# EAGLE board Resistor_Resistor (EAGLE 8.3.0), part 28 of 32
## Placement (x,y rotation side) (continued)
R34191  10K  [0201]  232.61,117.09 0 top
R34192  10K  [0201]  232.61,117.7 0 top
R34193  10K  [0201]  232.61,118.31 0 top
R34194  10K  [0201]  232.61,118.92 0 top
R34195  10K  [0201]  232.61,119.53 0 top
R34196  10K  [0201]  232.61,120.14 0 top
R34197  10K  [0201]  232.61,120.75 0 top
R34198  10K  [0201]  232.61,121.36 0 top
R34199  10K  [0201]  232.61,121.97 0 top
R34200  10K  [0201]  232.61,122.58 0 top
R34201  10K  [0201]  233.83,1.27 0 top
R34202  10K  [0201]  233.83,1.88 0 top
R34203  10K  [0201]  233.83,2.49 0 top
R34204  10K  [0201]  233.83,3.1 0 top
R34205  10K  [0201]  233.83,3.71 0 top
R34206  10K  [0201]  233.83,4.32 0 top
R34207  10K  [0201]  233.83,4.93 0 top
R34208  10K  [0201]  233.83,5.54 0 top
R34209  10K  [0201]  233.83,6.15 0 top
R34210  10K  [0201]  233.83,6.76 0 top
R34211  10K  [0201]  233.83,7.37 0 top
R34212  10K  [0201]  233.83,7.98 0 top
R34213  10K  [0201]  233.83,8.59 0 top
R34214  10K  [0201]  233.83,9.19 0 top
R34215  10K  [0201]  233.83,9.8 0 top
R34216  10K  [0201]  233.83,10.41 0 top
R34217  10K  [0201]  233.83,11.02 0 top
R34218  10K  [0201]  233.83,11.63 0 top
R34219  10K  [0201]  233.83,12.24 0 top
R34220  10K  [0201]  233.83,12.85 0 top
R34221  10K  [0201]  233.83,13.46 0 top
R34222  10K  [0201]  233.83,14.07 0 top
R34223  10K  [0201]  233.83,14.68 0 top
R34224  10K  [0201]  233.83,15.29 0 top
R34225  10K  [0201]  233.83,15.9 0 top
R34226  10K  [0201]  233.83,16.51 0 top
R34227  10K  [0201]  233.83,17.12 0 top
R34228  10K  [0201]  233.83,17.73 0 top
R34229  10K  [0201]  233.83,18.34 0 top
R34230  10K  [0201]  233.83,18.95 0 top
R34231  10K  [0201]  233.83,19.56 0 top
R34232  10K  [0201]  233.83,20.17 0 top
R34233  10K  [0201]  233.83,20.78 0 top
R34234  10K  [0201]  233.83,21.39 0 top
R34235  10K  [0201]  233.83,22 0 top
R34236  10K  [0201]  233.83,22.61 0 top
R34237  10K  [0201]  233.83,23.22 0 top
R34238  10K  [0201]  233.83,23.83 0 top
R34239  10K  [0201]  233.83,24.43 0 top
R34240  10K  [0201]  233.83,25.04 0 top
R34241  10K  [0201]  233.83,25.65 0 top
R34242  10K  [0201]  233.83,26.26 0 top
R34243  10K  [0201]  233.83,26.87 0 top
R34244  10K  [0201]  233.83,27.48 0 top
R34245  10K  [0201]  233.83,28.09 0 top
R34246  10K  [0201]  233.83,28.7 0 top
R34247  10K  [0201]  233.83,29.31 0 top
R34248  10K  [0201]  233.83,29.92 0 top
R34249  10K  [0201]  233.83,30.53 0 top
R34250  10K  [0201]  233.83,31.14 0 top
R34251  10K  [0201]  233.83,31.75 0 top
R34252  10K  [0201]  233.83,32.36 0 top
R34253  10K  [0201]  233.83,32.97 0 top
R34254  10K  [0201]  233.83,33.58 0 top
R34255  10K  [0201]  233.83,34.19 0 top
R34256  10K  [0201]  233.83,34.8 0 top
R34257  10K  [0201]  233.83,35.41 0 top
R34258  10K  [0201]  233.83,36.02 0 top
R34259  10K  [0201]  233.83,36.63 0 top
R34260  10K  [0201]  233.83,37.24 0 top
R34261  10K  [0201]  233.83,37.85 0 top
R34262  10K  [0201]  233.83,38.46 0 top
R34263  10K  [0201]  233.83,39.07 0 top
R34264  10K  [0201]  233.83,39.67 0 top
R34265  10K  [0201]  233.83,40.28 0 top
R34266  10K  [0201]  233.83,40.89 0 top
R34267  10K  [0201]  233.83,41.5 0 top
R34268  10K  [0201]  233.83,42.11 0 top
R34269  10K  [0201]  233.83,42.72 0 top
R34270  10K  [0201]  233.83,43.33 0 top
R34271  10K  [0201]  233.83,43.94 0 top
R34272  10K  [0201]  233.83,44.55 0 top
R34273  10K  [0201]  233.83,45.16 0 top
R34274  10K  [0201]  233.83,45.77 0 top
R34275  10K  [0201]  233.83,46.38 0 top
R34276  10K  [0201]  233.83,46.99 0 top
R34277  10K  [0201]  233.83,47.6 0 top
R34278  10K  [0201]  233.83,48.21 0 top
R34279  10K  [0201]  233.83,48.82 0 top
R34280  10K  [0201]  233.83,49.43 0 top
R34281  10K  [0201]  233.83,50.04 0 top
R34282  10K  [0201]  233.83,50.65 0 top
R34283  10K  [0201]  233.83,51.26 0 top
R34284  10K  [0201]  233.83,51.87 0 top
R34285  10K  [0201]  233.83,52.48 0 top
R34286  10K  [0201]  233.83,53.09 0 top
R34287  10K  [0201]  233.83,53.7 0 top
R34288  10K  [0201]  233.83,54.31 0 top
R34289  10K  [0201]  233.83,54.91 0 top
R34290  10K  [0201]  233.83,55.52 0 top
R34291  10K  [0201]  233.83,56.13 0 top
R34292  10K  [0201]  233.83,56.74 0 top
R34293  10K  [0201]  233.83,57.35 0 top
R34294  10K  [0201]  233.83,57.96 0 top
R34295  10K  [0201]  233.83,58.57 0 top
R34296  10K  [0201]  233.83,59.18 0 top
R34297  10K  [0201]  233.83,59.79 0 top
R34298  10K  [0201]  233.83,60.4 0 top
R34299  10K  [0201]  233.83,61.01 0 top
R34300  10K  [0201]  233.83,61.62 0 top
R34301  10K  [0201]  233.83,62.23 0 top
R34302  10K  [0201]  233.83,62.84 0 top
R34303  10K  [0201]  233.83,63.45 0 top
R34304  10K  [0201]  233.83,64.06 0 top
R34305  10K  [0201]  233.83,64.67 0 top
R34306  10K  [0201]  233.83,65.28 0 top
R34307  10K  [0201]  233.83,65.89 0 top
R34308  10K  [0201]  233.83,66.5 0 top
R34309  10K  [0201]  233.83,67.11 0 top
R34310  10K  [0201]  233.83,67.72 0 top
R34311  10K  [0201]  233.83,68.33 0 top
R34312  10K  [0201]  233.83,68.94 0 top
R34313  10K  [0201]  233.83,69.55 0 top
R34314  10K  [0201]  233.83,70.15 0 top
R34315  10K  [0201]  233.83,70.76 0 top
R34316  10K  [0201]  233.83,71.37 0 top
R34317  10K  [0201]  233.83,71.98 0 top
R34318  10K  [0201]  233.83,72.59 0 top
R34319  10K  [0201]  233.83,73.2 0 top
R34320  10K  [0201]  233.83,73.81 0 top
R34321  10K  [0201]  233.83,74.42 0 top
R34322  10K  [0201]  233.83,75.03 0 top
R34323  10K  [0201]  233.83,75.64 0 top
R34324  10K  [0201]  233.83,76.25 0 top
R34325  10K  [0201]  233.83,76.86 0 top
R34326  10K  [0201]  233.83,77.47 0 top
R34327  10K  [0201]  233.83,78.08 0 top
R34328  10K  [0201]  233.83,78.69 0 top
R34329  10K  [0201]  233.83,79.3 0 top
R34330  10K  [0201]  233.83,79.91 0 top
R34331  10K  [0201]  233.83,80.52 0 top
R34332  10K  [0201]  233.83,81.13 0 top
R34333  10K  [0201]  233.83,81.74 0 top
R34334  10K  [0201]  233.83,82.35 0 top
R34335  10K  [0201]  233.83,82.96 0 top
R34336  10K  [0201]  233.83,83.57 0 top
R34337  10K  [0201]  233.83,84.18 0 top
R34338  10K  [0201]  233.83,84.79 0 top
R34339  10K  [0201]  233.83,85.39 0 top
R34340  10K  [0201]  233.83,86 0 top
R34341  10K  [0201]  233.83,86.61 0 top
R34342  10K  [0201]  233.83,87.22 0 top
R34343  10K  [0201]  233.83,87.83 0 top
R34344  10K  [0201]  233.83,88.44 0 top
R34345  10K  [0201]  233.83,89.05 0 top
R34346  10K  [0201]  233.83,89.66 0 top
R34347  10K  [0201]  233.83,90.27 0 top
R34348  10K  [0201]  233.83,90.88 0 top
R34349  10K  [0201]  233.83,91.49 0 top
R34350  10K  [0201]  233.83,92.1 0 top
R34351  10K  [0201]  233.83,92.71 0 top
R34352  10K  [0201]  233.83,93.32 0 top
R34353  10K  [0201]  233.83,93.93 0 top
R34354  10K  [0201]  233.83,94.54 0 top
R34355  10K  [0201]  233.83,95.15 0 top
R34356  10K  [0201]  233.83,95.76 0 top
R34357  10K  [0201]  233.83,96.37 0 top
R34358  10K  [0201]  233.83,96.98 0 top
R34359  10K  [0201]  233.83,97.59 0 top
R34360  10K  [0201]  233.83,98.2 0 top
R34361  10K  [0201]  233.83,98.81 0 top
R34362  10K  [0201]  233.83,99.42 0 top
R34363  10K  [0201]  233.83,100.03 0 top
R34364  10K  [0201]  233.83,100.63 0 top
R34365  10K  [0201]  233.83,101.24 0 top
R34366  10K  [0201]  233.83,101.85 0 top
R34367  10K  [0201]  233.83,102.46 0 top
R34368  10K  [0201]  233.83,103.07 0 top
R34369  10K  [0201]  233.83,103.68 0 top
R34370  10K  [0201]  233.83,104.29 0 top
R34371  10K  [0201]  233.83,104.9 0 top
R34372  10K  [0201]  233.83,105.51 0 top
R34373  10K  [0201]  233.83,106.12 0 top
R34374  10K  [0201]  233.83,106.73 0 top
R34375  10K  [0201]  233.83,107.34 0 top
R34376  10K  [0201]  233.83,107.95 0 top
R34377  10K  [0201]  233.83,108.56 0 top
R34378  10K  [0201]  233.83,109.17 0 top
R34379  10K  [0201]  233.83,109.78 0 top
R34380  10K  [0201]  233.83,110.39 0 top
R34381  10K  [0201]  233.83,111 0 top
R34382  10K  [0201]  233.83,111.61 0 top
R34383  10K  [0201]  233.83,112.22 0 top
R34384  10K  [0201]  233.83,112.83 0 top
R34385  10K  [0201]  233.83,113.44 0 top
R34386  10K  [0201]  233.83,114.05 0 top
R34387  10K  [0201]  233.83,114.66 0 top
R34388  10K  [0201]  233.83,115.27 0 top
R34389  10K  [0201]  233.83,115.87 0 top
R34390  10K  [0201]  233.83,116.48 0 top
R34391  10K  [0201]  233.83,117.09 0 top
R34392  10K  [0201]  233.83,117.7 0 top
R34393  10K  [0201]  233.83,118.31 0 top
R34394  10K  [0201]  233.83,118.92 0 top
R34395  10K  [0201]  233.83,119.53 0 top
R34396  10K  [0201]  233.83,120.14 0 top
R34397  10K  [0201]  233.83,120.75 0 top
R34398  10K  [0201]  233.83,121.36 0 top
R34399  10K  [0201]  233.83,121.97 0 top
R34400  10K  [0201]  233.83,122.58 0 top
R34401  10K  [0201]  235.05,1.27 0 top
R34402  10K  [0201]  235.05,1.88 0 top
R34403  10K  [0201]  235.05,2.49 0 top
R34404  10K  [0201]  235.05,3.1 0 top
R34405  10K  [0201]  235.05,3.71 0 top
R34406  10K  [0201]  235.05,4.32 0 top
R34407  10K  [0201]  235.05,4.93 0 top
R34408  10K  [0201]  235.05,5.54 0 top
R34409  10K  [0201]  235.05,6.15 0 top
R34410  10K  [0201]  235.05,6.76 0 top
R34411  10K  [0201]  235.05,7.37 0 top
R34412  10K  [0201]  235.05,7.98 0 top
R34413  10K  [0201]  235.05,8.59 0 top
R34414  10K  [0201]  235.05,9.19 0 top
R34415  10K  [0201]  235.05,9.8 0 top
R34416  10K  [0201]  235.05,10.41 0 top
R34417  10K  [0201]  235.05,11.02 0 top
R34418  10K  [0201]  235.05,11.63 0 top
R34419  10K  [0201]  235.05,12.24 0 top
R34420  10K  [0201]  235.05,12.85 0 top
R34421  10K  [0201]  235.05,13.46 0 top
R34422  10K  [0201]  235.05,14.07 0 top
R34423  10K  [0201]  235.05,14.68 0 top
R34424  10K  [0201]  235.05,15.29 0 top
R34425  10K  [0201]  235.05,15.9 0 top
R34426  10K  [0201]  235.05,16.51 0 top
R34427  10K  [0201]  235.05,17.12 0 top
R34428  10K  [0201]  235.05,17.73 0 top
R34429  10K  [0201]  235.05,18.34 0 top
R34430  10K  [0201]  235.05,18.95 0 top
R34431  10K  [0201]  235.05,19.56 0 top
R34432  10K  [0201]  235.05,20.17 0 top
R34433  10K  [0201]  235.05,20.78 0 top
R34434  10K  [0201]  235.05,21.39 0 top
R34435  10K  [0201]  235.05,22 0 top
R34436  10K  [0201]  235.05,22.61 0 top
R34437  10K  [0201]  235.05,23.22 0 top
R34438  10K  [0201]  235.05,23.83 0 top
R34439  10K  [0201]  235.05,24.43 0 top
R34440  10K  [0201]  235.05,25.04 0 top
R34441  10K  [0201]  235.05,25.65 0 top
R34442  10K  [0201]  235.05,26.26 0 top
R34443  10K  [0201]  235.05,26.87 0 top
R34444  10K  [0201]  235.05,27.48 0 top
R34445  10K  [0201]  235.05,28.09 0 top
R34446  10K  [0201]  235.05,28.7 0 top
R34447  10K  [0201]  235.05,29.31 0 top
R34448  10K  [0201]  235.05,29.92 0 top
R34449  10K  [0201]  235.05,30.53 0 top
R34450  10K  [0201]  235.05,31.14 0 top
R34451  10K  [0201]  235.05,31.75 0 top
R34452  10K  [0201]  235.05,32.36 0 top
R34453  10K  [0201]  235.05,32.97 0 top
R34454  10K  [0201]  235.05,33.58 0 top
R34455  10K  [0201]  235.05,34.19 0 top
R34456  10K  [0201]  235.05,34.8 0 top
R34457  10K  [0201]  235.05,35.41 0 top
R34458  10K  [0201]  235.05,36.02 0 top
R34459  10K  [0201]  235.05,36.63 0 top
R34460  10K  [0201]  235.05,37.24 0 top
R34461  10K  [0201]  235.05,37.85 0 top
R34462  10K  [0201]  235.05,38.46 0 top
R34463  10K  [0201]  235.05,39.07 0 top
R34464  10K  [0201]  235.05,39.67 0 top
R34465  10K  [0201]  235.05,40.28 0 top
R34466  10K  [0201]  235.05,40.89 0 top
R34467  10K  [0201]  235.05,41.5 0 top
R34468  10K  [0201]  235.05,42.11 0 top
R34469  10K  [0201]  235.05,42.72 0 top
R34470  10K  [0201]  235.05,43.33 0 top
R34471  10K  [0201]  235.05,43.94 0 top
R34472  10K  [0201]  235.05,44.55 0 top
R34473  10K  [0201]  235.05,45.16 0 top
R34474  10K  [0201]  235.05,45.77 0 top
R34475  10K  [0201]  235.05,46.38 0 top
R34476  10K  [0201]  235.05,46.99 0 top
R34477  10K  [0201]  235.05,47.6 0 top
R34478  10K  [0201]  235.05,48.21 0 top
R34479  10K  [0201]  235.05,48.82 0 top
R34480  10K  [0201]  235.05,49.43 0 top
R34481  10K  [0201]  235.05,50.04 0 top
R34482  10K  [0201]  235.05,50.65 0 top
R34483  10K  [0201]  235.05,51.26 0 top
R34484  10K  [0201]  235.05,51.87 0 top
R34485  10K  [0201]  235.05,52.48 0 top
R34486  10K  [0201]  235.05,53.09 0 top
R34487  10K  [0201]  235.05,53.7 0 top
R34488  10K  [0201]  235.05,54.31 0 top
R34489  10K  [0201]  235.05,54.91 0 top
R34490  10K  [0201]  235.05,55.52 0 top
R34491  10K  [0201]  235.05,56.13 0 top
R34492  10K  [0201]  235.05,56.74 0 top
R34493  10K  [0201]  235.05,57.35 0 top
R34494  10K  [0201]  235.05,57.96 0 top
R34495  10K  [0201]  235.05,58.57 0 top
R34496  10K  [0201]  235.05,59.18 0 top
R34497  10K  [0201]  235.05,59.79 0 top
R34498  10K  [0201]  235.05,60.4 0 top
R34499  10K  [0201]  235.05,61.01 0 top
R34500  10K  [0201]  235.05,61.62 0 top
R34501  10K  [0201]  235.05,62.23 0 top
R34502  10K  [0201]  235.05,62.84 0 top
R34503  10K  [0201]  235.05,63.45 0 top
R34504  10K  [0201]  235.05,64.06 0 top
R34505  10K  [0201]  235.05,64.67 0 top
R34506  10K  [0201]  235.05,65.28 0 top
R34507  10K  [0201]  235.05,65.89 0 top
R34508  10K  [0201]  235.05,66.5 0 top
R34509  10K  [0201]  235.05,67.11 0 top
R34510  10K  [0201]  235.05,67.72 0 top
R34511  10K  [0201]  235.05,68.33 0 top
R34512  10K  [0201]  235.05,68.94 0 top
R34513  10K  [0201]  235.05,69.55 0 top
R34514  10K  [0201]  235.05,70.15 0 top
R34515  10K  [0201]  235.05,70.76 0 top
R34516  10K  [0201]  235.05,71.37 0 top
R34517  10K  [0201]  235.05,71.98 0 top
R34518  10K  [0201]  235.05,72.59 0 top
R34519  10K  [0201]  235.05,73.2 0 top
R34520  10K  [0201]  235.05,73.81 0 top
R34521  10K  [0201]  235.05,74.42 0 top
R34522  10K  [0201]  235.05,75.03 0 top
R34523  10K  [0201]  235.05,75.64 0 top
R34524  10K  [0201]  235.05,76.25 0 top
R34525  10K  [0201]  235.05,76.86 0 top
R34526  10K  [0201]  235.05,77.47 0 top
R34527  10K  [0201]  235.05,78.08 0 top
R34528  10K  [0201]  235.05,78.69 0 top
R34529  10K  [0201]  235.05,79.3 0 top
R34530  10K  [0201]  235.05,79.91 0 top
R34531  10K  [0201]  235.05,80.52 0 top
R34532  10K  [0201]  235.05,81.13 0 top
R34533  10K  [0201]  235.05,81.74 0 top
R34534  10K  [0201]  235.05,82.35 0 top
R34535  10K  [0201]  235.05,82.96 0 top
R34536  10K  [0201]  235.05,83.57 0 top
R34537  10K  [0201]  235.05,84.18 0 top
R34538  10K  [0201]  235.05,84.79 0 top
R34539  10K  [0201]  235.05,85.39 0 top
R34540  10K  [0201]  235.05,86 0 top
R34541  10K  [0201]  235.05,86.61 0 top
R34542  10K  [0201]  235.05,87.22 0 top
R34543  10K  [0201]  235.05,87.83 0 top
R34544  10K  [0201]  235.05,88.44 0 top
R34545  10K  [0201]  235.05,89.05 0 top
R34546  10K  [0201]  235.05,89.66 0 top
R34547  10K  [0201]  235.05,90.27 0 top
R34548  10K  [0201]  235.05,90.88 0 top
R34549  10K  [0201]  235.05,91.49 0 top
R34550  10K  [0201]  235.05,92.1 0 top
R34551  10K  [0201]  235.05,92.71 0 top
R34552  10K  [0201]  235.05,93.32 0 top
R34553  10K  [0201]  235.05,93.93 0 top
R34554  10K  [0201]  235.05,94.54 0 top
R34555  10K  [0201]  235.05,95.15 0 top
R34556  10K  [0201]  235.05,95.76 0 top
R34557  10K  [0201]  235.05,96.37 0 top
R34558  10K  [0201]  235.05,96.98 0 top
R34559  10K  [0201]  235.05,97.59 0 top
R34560  10K  [0201]  235.05,98.2 0 top
R34561  10K  [0201]  235.05,98.81 0 top
R34562  10K  [0201]  235.05,99.42 0 top
R34563  10K  [0201]  235.05,100.03 0 top
R34564  10K  [0201]  235.05,100.63 0 top
R34565  10K  [0201]  235.05,101.24 0 top
R34566  10K  [0201]  235.05,101.85 0 top
R34567  10K  [0201]  235.05,102.46 0 top
R34568  10K  [0201]  235.05,103.07 0 top
R34569  10K  [0201]  235.05,103.68 0 top
R34570  10K  [0201]  235.05,104.29 0 top
R34571  10K  [0201]  235.05,104.9 0 top
R34572  10K  [0201]  235.05,105.51 0 top
R34573  10K  [0201]  235.05,106.12 0 top
R34574  10K  [0201]  235.05,106.73 0 top
R34575  10K  [0201]  235.05,107.34 0 top
R34576  10K  [0201]  235.05,107.95 0 top
R34577  10K  [0201]  235.05,108.56 0 top
R34578  10K  [0201]  235.05,109.17 0 top
R34579  10K  [0201]  235.05,109.78 0 top
R34580  10K  [0201]  235.05,110.39 0 top
R34581  10K  [0201]  235.05,111 0 top
R34582  10K  [0201]  235.05,111.61 0 top
R34583  10K  [0201]  235.05,112.22 0 top
R34584  10K  [0201]  235.05,112.83 0 top
R34585  10K  [0201]  235.05,113.44 0 top
R34586  10K  [0201]  235.05,114.05 0 top
R34587  10K  [0201]  235.05,114.66 0 top
R34588  10K  [0201]  235.05,115.27 0 top
R34589  10K  [0201]  235.05,115.87 0 top
R34590  10K  [0201]  235.05,116.48 0 top
R34591  10K  [0201]  235.05,117.09 0 top
R34592  10K  [0201]  235.05,117.7 0 top
R34593  10K  [0201]  235.05,118.31 0 top
R34594  10K  [0201]  235.05,118.92 0 top
R34595  10K  [0201]  235.05,119.53 0 top
R34596  10K  [0201]  235.05,120.14 0 top
R34597  10K  [0201]  235.05,120.75 0 top
R34598  10K  [0201]  235.05,121.36 0 top
R34599  10K  [0201]  235.05,121.97 0 top
R34600  10K  [0201]  235.05,122.58 0 top
R34601  10K  [0201]  236.27,1.27 0 top
R34602  10K  [0201]  236.27,1.88 0 top
R34603  10K  [0201]  236.27,2.49 0 top
R34604  10K  [0201]  236.27,3.1 0 top
R34605  10K  [0201]  236.27,3.71 0 top
R34606  10K  [0201]  236.27,4.32 0 top
R34607  10K  [0201]  236.27,4.93 0 top
R34608  10K  [0201]  236.27,5.54 0 top
R34609  10K  [0201]  236.27,6.15 0 top
R34610  10K  [0201]  236.27,6.76 0 top
R34611  10K  [0201]  236.27,7.37 0 top
R34612  10K  [0201]  236.27,7.98 0 top
R34613  10K  [0201]  236.27,8.59 0 top
R34614  10K  [0201]  236.27,9.19 0 top
R34615  10K  [0201]  236.27,9.8 0 top
R34616  10K  [0201]  236.27,10.41 0 top
R34617  10K  [0201]  236.27,11.02 0 top
R34618  10K  [0201]  236.27,11.63 0 top
R34619  10K  [0201]  236.27,12.24 0 top
R34620  10K  [0201]  236.27,12.85 0 top
R34621  10K  [0201]  236.27,13.46 0 top
R34622  10K  [0201]  236.27,14.07 0 top
R34623  10K  [0201]  236.27,14.68 0 top
R34624  10K  [0201]  236.27,15.29 0 top
R34625  10K  [0201]  236.27,15.9 0 top
R34626  10K  [0201]  236.27,16.51 0 top
R34627  10K  [0201]  236.27,17.12 0 top
R34628  10K  [0201]  236.27,17.73 0 top
R34629  10K  [0201]  236.27,18.34 0 top
R34630  10K  [0201]  236.27,18.95 0 top
R34631  10K  [0201]  236.27,19.56 0 top
R34632  10K  [0201]  236.27,20.17 0 top
R34633  10K  [0201]  236.27,20.78 0 top
R34634  10K  [0201]  236.27,21.39 0 top
R34635  10K  [0201]  236.27,22 0 top
R34636  10K  [0201]  236.27,22.61 0 top
R34637  10K  [0201]  236.27,23.22 0 top
R34638  10K  [0201]  236.27,23.83 0 top
R34639  10K  [0201]  236.27,24.43 0 top
R34640  10K  [0201]  236.27,25.04 0 top
R34641  10K  [0201]  236.27,25.65 0 top
R34642  10K  [0201]  236.27,26.26 0 top
R34643  10K  [0201]  236.27,26.87 0 top
R34644  10K  [0201]  236.27,27.48 0 top
R34645  10K  [0201]  236.27,28.09 0 top
R34646  10K  [0201]  236.27,28.7 0 top
R34647  10K  [0201]  236.27,29.31 0 top
R34648  10K  [0201]  236.27,29.92 0 top
R34649  10K  [0201]  236.27,30.53 0 top
R34650  10K  [0201]  236.27,31.14 0 top
R34651  10K  [0201]  236.27,31.75 0 top
R34652  10K  [0201]  236.27,32.36 0 top
R34653  10K  [0201]  236.27,32.97 0 top
R34654  10K  [0201]  236.27,33.58 0 top
R34655  10K  [0201]  236.27,34.19 0 top
R34656  10K  [0201]  236.27,34.8 0 top
R34657  10K  [0201]  236.27,35.41 0 top
R34658  10K  [0201]  236.27,36.02 0 top
R34659  10K  [0201]  236.27,36.63 0 top
R34660  10K  [0201]  236.27,37.24 0 top
R34661  10K  [0201]  236.27,37.85 0 top
R34662  10K  [0201]  236.27,38.46 0 top
R34663  10K  [0201]  236.27,39.07 0 top
R34664  10K  [0201]  236.27,39.67 0 top
R34665  10K  [0201]  236.27,40.28 0 top
R34666  10K  [0201]  236.27,40.89 0 top
R34667  10K  [0201]  236.27,41.5 0 top
R34668  10K  [0201]  236.27,42.11 0 top
R34669  10K  [0201]  236.27,42.72 0 top
R34670  10K  [0201]  236.27,43.33 0 top
R34671  10K  [0201]  236.27,43.94 0 top
R34672  10K  [0201]  236.27,44.55 0 top
R34673  10K  [0201]  236.27,45.16 0 top
R34674  10K  [0201]  236.27,45.77 0 top
R34675  10K  [0201]  236.27,46.38 0 top
R34676  10K  [0201]  236.27,46.99 0 top
R34677  10K  [0201]  236.27,47.6 0 top
R34678  10K  [0201]  236.27,48.21 0 top
R34679  10K  [0201]  236.27,48.82 0 top
R34680  10K  [0201]  236.27,49.43 0 top
R34681  10K  [0201]  236.27,50.04 0 top
R34682  10K  [0201]  236.27,50.65 0 top
R34683  10K  [0201]  236.27,51.26 0 top
R34684  10K  [0201]  236.27,51.87 0 top
R34685  10K  [0201]  236.27,52.48 0 top
R34686  10K  [0201]  236.27,53.09 0 top
R34687  10K  [0201]  236.27,53.7 0 top
R34688  10K  [0201]  236.27,54.31 0 top
R34689  10K  [0201]  236.27,54.91 0 top
R34690  10K  [0201]  236.27,55.52 0 top
R34691  10K  [0201]  236.27,56.13 0 top
R34692  10K  [0201]  236.27,56.74 0 top
R34693  10K  [0201]  236.27,57.35 0 top
R34694  10K  [0201]  236.27,57.96 0 top
R34695  10K  [0201]  236.27,58.57 0 top
R34696  10K  [0201]  236.27,59.18 0 top
R34697  10K  [0201]  236.27,59.79 0 top
R34698  10K  [0201]  236.27,60.4 0 top
R34699  10K  [0201]  236.27,61.01 0 top
R34700  10K  [0201]  236.27,61.62 0 top
R34701  10K  [0201]  236.27,62.23 0 top
R34702  10K  [0201]  236.27,62.84 0 top
R34703  10K  [0201]  236.27,63.45 0 top
R34704  10K  [0201]  236.27,64.06 0 top
R34705  10K  [0201]  236.27,64.67 0 top
R34706  10K  [0201]  236.27,65.28 0 top
R34707  10K  [0201]  236.27,65.89 0 top
R34708  10K  [0201]  236.27,66.5 0 top
R34709  10K  [0201]  236.27,67.11 0 top
R34710  10K  [0201]  236.27,67.72 0 top
R34711  10K  [0201]  236.27,68.33 0 top
R34712  10K  [0201]  236.27,68.94 0 top
R34713  10K  [0201]  236.27,69.55 0 top
R34714  10K  [0201]  236.27,70.15 0 top
R34715  10K  [0201]  236.27,70.76 0 top
R34716  10K  [0201]  236.27,71.37 0 top
R34717  10K  [0201]  236.27,71.98 0 top
R34718  10K  [0201]  236.27,72.59 0 top
R34719  10K  [0201]  236.27,73.2 0 top
R34720  10K  [0201]  236.27,73.81 0 top
R34721  10K  [0201]  236.27,74.42 0 top
R34722  10K  [0201]  236.27,75.03 0 top
R34723  10K  [0201]  236.27,75.64 0 top
R34724  10K  [0201]  236.27,76.25 0 top
R34725  10K  [0201]  236.27,76.86 0 top
R34726  10K  [0201]  236.27,77.47 0 top
R34727  10K  [0201]  236.27,78.08 0 top
R34728  10K  [0201]  236.27,78.69 0 top
R34729  10K  [0201]  236.27,79.3 0 top
R34730  10K  [0201]  236.27,79.91 0 top
R34731  10K  [0201]  236.27,80.52 0 top
R34732  10K  [0201]  236.27,81.13 0 top
R34733  10K  [0201]  236.27,81.74 0 top
R34734  10K  [0201]  236.27,82.35 0 top
R34735  10K  [0201]  236.27,82.96 0 top
R34736  10K  [0201]  236.27,83.57 0 top
R34737  10K  [0201]  236.27,84.18 0 top
R34738  10K  [0201]  236.27,84.79 0 top
R34739  10K  [0201]  236.27,85.39 0 top
R34740  10K  [0201]  236.27,86 0 top
R34741  10K  [0201]  236.27,86.61 0 top
R34742  10K  [0201]  236.27,87.22 0 top
R34743  10K  [0201]  236.27,87.83 0 top
R34744  10K  [0201]  236.27,88.44 0 top
R34745  10K  [0201]  236.27,89.05 0 top
R34746  10K  [0201]  236.27,89.66 0 top
R34747  10K  [0201]  236.27,90.27 0 top
R34748  10K  [0201]  236.27,90.88 0 top
R34749  10K  [0201]  236.27,91.49 0 top
R34750  10K  [0201]  236.27,92.1 0 top
R34751  10K  [0201]  236.27,92.71 0 top
R34752  10K  [0201]  236.27,93.32 0 top
R34753  10K  [0201]  236.27,93.93 0 top
R34754  10K  [0201]  236.27,94.54 0 top
R34755  10K  [0201]  236.27,95.15 0 top
R34756  10K  [0201]  236.27,95.76 0 top
R34757  10K  [0201]  236.27,96.37 0 top
R34758  10K  [0201]  236.27,96.98 0 top
R34759  10K  [0201]  236.27,97.59 0 top
R34760  10K  [0201]  236.27,98.2 0 top
R34761  10K  [0201]  236.27,98.81 0 top
R34762  10K  [0201]  236.27,99.42 0 top
R34763  10K  [0201]  236.27,100.03 0 top
R34764  10K  [0201]  236.27,100.63 0 top
R34765  10K  [0201]  236.27,101.24 0 top
R34766  10K  [0201]  236.27,101.85 0 top
R34767  10K  [0201]  236.27,102.46 0 top
R34768  10K  [0201]  236.27,103.07 0 top
R34769  10K  [0201]  236.27,103.68 0 top
R34770  10K  [0201]  236.27,104.29 0 top
R34771  10K  [0201]  236.27,104.9 0 top
R34772  10K  [0201]  236.27,105.51 0 top
R34773  10K  [0201]  236.27,106.12 0 top
R34774  10K  [0201]  236.27,106.73 0 top
R34775  10K  [0201]  236.27,107.34 0 top
R34776  10K  [0201]  236.27,107.95 0 top
R34777  10K  [0201]  236.27,108.56 0 top
R34778  10K  [0201]  236.27,109.17 0 top
R34779  10K  [0201]  236.27,109.78 0 top
R34780  10K  [0201]  236.27,110.39 0 top
R34781  10K  [0201]  236.27,111 0 top
R34782  10K  [0201]  236.27,111.61 0 top
R34783  10K  [0201]  236.27,112.22 0 top
R34784  10K  [0201]  236.27,112.83 0 top
R34785  10K  [0201]  236.27,113.44 0 top
R34786  10K  [0201]  236.27,114.05 0 top
R34787  10K  [0201]  236.27,114.66 0 top
R34788  10K  [0201]  236.27,115.27 0 top
R34789  10K  [0201]  236.27,115.87 0 top
R34790  10K  [0201]  236.27,116.48 0 top
R34791  10K  [0201]  236.27,117.09 0 top
R34792  10K  [0201]  236.27,117.7 0 top
R34793  10K  [0201]  236.27,118.31 0 top
R34794  10K  [0201]  236.27,118.92 0 top
R34795  10K  [0201]  236.27,119.53 0 top
R34796  10K  [0201]  236.27,120.14 0 top
R34797  10K  [0201]  236.27,120.75 0 top
R34798  10K  [0201]  236.27,121.36 0 top
R34799  10K  [0201]  236.27,121.97 0 top
R34800  10K  [0201]  236.27,122.58 0 top
R34801  10K  [0201]  237.49,1.27 0 top
R34802  10K  [0201]  237.49,1.88 0 top
R34803  10K  [0201]  237.49,2.49 0 top
R34804  10K  [0201]  237.49,3.1 0 top
R34805  10K  [0201]  237.49,3.71 0 top
R34806  10K  [0201]  237.49,4.32 0 top
R34807  10K  [0201]  237.49,4.93 0 top
R34808  10K  [0201]  237.49,5.54 0 top
R34809  10K  [0201]  237.49,6.15 0 top
R34810  10K  [0201]  237.49,6.76 0 top
R34811  10K  [0201]  237.49,7.37 0 top
R34812  10K  [0201]  237.49,7.98 0 top
R34813  10K  [0201]  237.49,8.59 0 top
R34814  10K  [0201]  237.49,9.19 0 top
R34815  10K  [0201]  237.49,9.8 0 top
R34816  10K  [0201]  237.49,10.41 0 top
R34817  10K  [0201]  237.49,11.02 0 top
R34818  10K  [0201]  237.49,11.63 0 top
R34819  10K  [0201]  237.49,12.24 0 top
R34820  10K  [0201]  237.49,12.85 0 top
R34821  10K  [0201]  237.49,13.46 0 top
R34822  10K  [0201]  237.49,14.07 0 top
R34823  10K  [0201]  237.49,14.68 0 top
R34824  10K  [0201]  237.49,15.29 0 top
R34825  10K  [0201]  237.49,15.9 0 top
R34826  10K  [0201]  237.49,16.51 0 top
R34827  10K  [0201]  237.49,17.12 0 top
R34828  10K  [0201]  237.49,17.73 0 top
R34829  10K  [0201]  237.49,18.34 0 top
R34830  10K  [0201]  237.49,18.95 0 top
R34831  10K  [0201]  237.49,19.56 0 top
R34832  10K  [0201]  237.49,20.17 0 top
R34833  10K  [0201]  237.49,20.78 0 top
R34834  10K  [0201]  237.49,21.39 0 top
R34835  10K  [0201]  237.49,22 0 top
R34836  10K  [0201]  237.49,22.61 0 top
R34837  10K  [0201]  237.49,23.22 0 top
R34838  10K  [0201]  237.49,23.83 0 top
R34839  10K  [0201]  237.49,24.43 0 top
R34840  10K  [0201]  237.49,25.04 0 top
R34841  10K  [0201]  237.49,25.65 0 top
R34842  10K  [0201]  237.49,26.26 0 top
R34843  10K  [0201]  237.49,26.87 0 top
R34844  10K  [0201]  237.49,27.48 0 top
R34845  10K  [0201]  237.49,28.09 0 top
R34846  10K  [0201]  237.49,28.7 0 top
R34847  10K  [0201]  237.49,29.31 0 top
R34848  10K  [0201]  237.49,29.92 0 top
R34849  10K  [0201]  237.49,30.53 0 top
R34850  10K  [0201]  237.49,31.14 0 top
R34851  10K  [0201]  237.49,31.75 0 top
R34852  10K  [0201]  237.49,32.36 0 top
R34853  10K  [0201]  237.49,32.97 0 top
R34854  10K  [0201]  237.49,33.58 0 top
R34855  10K  [0201]  237.49,34.19 0 top
R34856  10K  [0201]  237.49,34.8 0 top
R34857  10K  [0201]  237.49,35.41 0 top
R34858  10K  [0201]  237.49,36.02 0 top
R34859  10K  [0201]  237.49,36.63 0 top
R34860  10K  [0201]  237.49,37.24 0 top
R34861  10K  [0201]  237.49,37.85 0 top
R34862  10K  [0201]  237.49,38.46 0 top
R34863  10K  [0201]  237.49,39.07 0 top
R34864  10K  [0201]  237.49,39.67 0 top
R34865  10K  [0201]  237.49,40.28 0 top
R34866  10K  [0201]  237.49,40.89 0 top
R34867  10K  [0201]  237.49,41.5 0 top
R34868  10K  [0201]  237.49,42.11 0 top
R34869  10K  [0201]  237.49,42.72 0 top
R34870  10K  [0201]  237.49,43.33 0 top
R34871  10K  [0201]  237.49,43.94 0 top
R34872  10K  [0201]  237.49,44.55 0 top
R34873  10K  [0201]  237.49,45.16 0 top
R34874  10K  [0201]  237.49,45.77 0 top
R34875  10K  [0201]  237.49,46.38 0 top
R34876  10K  [0201]  237.49,46.99 0 top
R34877  10K  [0201]  237.49,47.6 0 top
R34878  10K  [0201]  237.49,48.21 0 top
R34879  10K  [0201]  237.49,48.82 0 top
R34880  10K  [0201]  237.49,49.43 0 top
R34881  10K  [0201]  237.49,50.04 0 top
R34882  10K  [0201]  237.49,50.65 0 top
R34883  10K  [0201]  237.49,51.26 0 top
R34884  10K  [0201]  237.49,51.87 0 top
R34885  10K  [0201]  237.49,52.48 0 top
R34886  10K  [0201]  237.49,53.09 0 top
R34887  10K  [0201]  237.49,53.7 0 top
R34888  10K  [0201]  237.49,54.31 0 top
R34889  10K  [0201]  237.49,54.91 0 top
R34890  10K  [0201]  237.49,55.52 0 top
R34891  10K  [0201]  237.49,56.13 0 top
R34892  10K  [0201]  237.49,56.74 0 top
R34893  10K  [0201]  237.49,57.35 0 top
R34894  10K  [0201]  237.49,57.96 0 top
R34895  10K  [0201]  237.49,58.57 0 top
R34896  10K  [0201]  237.49,59.18 0 top
R34897  10K  [0201]  237.49,59.79 0 top
R34898  10K  [0201]  237.49,60.4 0 top
R34899  10K  [0201]  237.49,61.01 0 top
R34900  10K  [0201]  237.49,61.62 0 top
R34901  10K  [0201]  237.49,62.23 0 top
R34902  10K  [0201]  237.49,62.84 0 top
R34903  10K  [0201]  237.49,63.45 0 top
R34904  10K  [0201]  237.49,64.06 0 top
R34905  10K  [0201]  237.49,64.67 0 top
R34906  10K  [0201]  237.49,65.28 0 top
R34907  10K  [0201]  237.49,65.89 0 top
R34908  10K  [0201]  237.49,66.5 0 top
R34909  10K  [0201]  237.49,67.11 0 top
R34910  10K  [0201]  237.49,67.72 0 top
R34911  10K  [0201]  237.49,68.33 0 top
R34912  10K  [0201]  237.49,68.94 0 top
R34913  10K  [0201]  237.49,69.55 0 top
R34914  10K  [0201]  237.49,70.15 0 top
R34915  10K  [0201]  237.49,70.76 0 top
R34916  10K  [0201]  237.49,71.37 0 top
R34917  10K  [0201]  237.49,71.98 0 top
R34918  10K  [0201]  237.49,72.59 0 top
R34919  10K  [0201]  237.49,73.2 0 top
R34920  10K  [0201]  237.49,73.81 0 top
R34921  10K  [0201]  237.49,74.42 0 top
R34922  10K  [0201]  237.49,75.03 0 top
R34923  10K  [0201]  237.49,75.64 0 top
R34924  10K  [0201]  237.49,76.25 0 top
R34925  10K  [0201]  237.49,76.86 0 top
R34926  10K  [0201]  237.49,77.47 0 top
R34927  10K  [0201]  237.49,78.08 0 top
R34928  10K  [0201]  237.49,78.69 0 top
R34929  10K  [0201]  237.49,79.3 0 top
R34930  10K  [0201]  237.49,79.91 0 top
R34931  10K  [0201]  237.49,80.52 0 top
R34932  10K  [0201]  237.49,81.13 0 top
R34933  10K  [0201]  237.49,81.74 0 top
R34934  10K  [0201]  237.49,82.35 0 top
R34935  10K  [0201]  237.49,82.96 0 top
R34936  10K  [0201]  237.49,83.57 0 top
R34937  10K  [0201]  237.49,84.18 0 top
R34938  10K  [0201]  237.49,84.79 0 top
R34939  10K  [0201]  237.49,85.39 0 top
R34940  10K  [0201]  237.49,86 0 top
R34941  10K  [0201]  237.49,86.61 0 top
R34942  10K  [0201]  237.49,87.22 0 top
R34943  10K  [0201]  237.49,87.83 0 top
R34944  10K  [0201]  237.49,88.44 0 top
R34945  10K  [0201]  237.49,89.05 0 top
R34946  10K  [0201]  237.49,89.66 0 top
R34947  10K  [0201]  237.49,90.27 0 top
R34948  10K  [0201]  237.49,90.88 0 top
R34949  10K  [0201]  237.49,91.49 0 top
R34950  10K  [0201]  237.49,92.1 0 top
R34951  10K  [0201]  237.49,92.71 0 top
R34952  10K  [0201]  237.49,93.32 0 top
R34953  10K  [0201]  237.49,93.93 0 top
R34954  10K  [0201]  237.49,94.54 0 top
R34955  10K  [0201]  237.49,95.15 0 top
R34956  10K  [0201]  237.49,95.76 0 top
R34957  10K  [0201]  237.49,96.37 0 top
R34958  10K  [0201]  237.49,96.98 0 top
R34959  10K  [0201]  237.49,97.59 0 top
R34960  10K  [0201]  237.49,98.2 0 top
R34961  10K  [0201]  237.49,98.81 0 top
R34962  10K  [0201]  237.49,99.42 0 top
R34963  10K  [0201]  237.49,100.03 0 top
R34964  10K  [0201]  237.49,100.63 0 top
R34965  10K  [0201]  237.49,101.24 0 top
R34966  10K  [0201]  237.49,101.85 0 top
R34967  10K  [0201]  237.49,102.46 0 top
R34968  10K  [0201]  237.49,103.07 0 top
R34969  10K  [0201]  237.49,103.68 0 top
R34970  10K  [0201]  237.49,104.29 0 top
R34971  10K  [0201]  237.49,104.9 0 top
R34972  10K  [0201]  237.49,105.51 0 top
R34973  10K  [0201]  237.49,106.12 0 top
R34974  10K  [0201]  237.49,106.73 0 top
R34975  10K  [0201]  237.49,107.34 0 top
R34976  10K  [0201]  237.49,107.95 0 top
R34977  10K  [0201]  237.49,108.56 0 top
R34978  10K  [0201]  237.49,109.17 0 top
R34979  10K  [0201]  237.49,109.78 0 top
R34980  10K  [0201]  237.49,110.39 0 top
R34981  10K  [0201]  237.49,111 0 top
R34982  10K  [0201]  237.49,111.61 0 top
R34983  10K  [0201]  237.49,112.22 0 top
R34984  10K  [0201]  237.49,112.83 0 top
R34985  10K  [0201]  237.49,113.44 0 top
R34986  10K  [0201]  237.49,114.05 0 top
R34987  10K  [0201]  237.49,114.66 0 top
R34988  10K  [0201]  237.49,115.27 0 top
R34989  10K  [0201]  237.49,115.87 0 top
R34990  10K  [0201]  237.49,116.48 0 top
R34991  10K  [0201]  237.49,117.09 0 top
R34992  10K  [0201]  237.49,117.7 0 top
R34993  10K  [0201]  237.49,118.31 0 top
R34994  10K  [0201]  237.49,118.92 0 top
R34995  10K  [0201]  237.49,119.53 0 top
R34996  10K  [0201]  237.49,120.14 0 top
R34997  10K  [0201]  237.49,120.75 0 top
R34998  10K  [0201]  237.49,121.36 0 top
R34999  10K  [0201]  237.49,121.97 0 top
R35000  10K  [0201]  237.49,122.58 0 top
R35001  10K  [0201]  238.71,1.27 0 top
R35002  10K  [0201]  238.71,1.88 0 top
R35003  10K  [0201]  238.71,2.49 0 top
R35004  10K  [0201]  238.71,3.1 0 top
R35005  10K  [0201]  238.71,3.71 0 top
R35006  10K  [0201]  238.71,4.32 0 top
R35007  10K  [0201]  238.71,4.93 0 top
R35008  10K  [0201]  238.71,5.54 0 top
R35009  10K  [0201]  238.71,6.15 0 top
R35010  10K  [0201]  238.71,6.76 0 top
R35011  10K  [0201]  238.71,7.37 0 top
R35012  10K  [0201]  238.71,7.98 0 top
R35013  10K  [0201]  238.71,8.59 0 top
R35014  10K  [0201]  238.71,9.19 0 top
R35015  10K  [0201]  238.71,9.8 0 top
R35016  10K  [0201]  238.71,10.41 0 top
R35017  10K  [0201]  238.71,11.02 0 top
R35018  10K  [0201]  238.71,11.63 0 top
R35019  10K  [0201]  238.71,12.24 0 top
R35020  10K  [0201]  238.71,12.85 0 top
R35021  10K  [0201]  238.71,13.46 0 top
R35022  10K  [0201]  238.71,14.07 0 top
R35023  10K  [0201]  238.71,14.68 0 top
R35024  10K  [0201]  238.71,15.29 0 top
R35025  10K  [0201]  238.71,15.9 0 top
R35026  10K  [0201]  238.71,16.51 0 top
R35027  10K  [0201]  238.71,17.12 0 top
R35028  10K  [0201]  238.71,17.73 0 top
R35029  10K  [0201]  238.71,18.34 0 top
R35030  10K  [0201]  238.71,18.95 0 top
R35031  10K  [0201]  238.71,19.56 0 top
R35032  10K  [0201]  238.71,20.17 0 top
R35033  10K  [0201]  238.71,20.78 0 top
R35034  10K  [0201]  238.71,21.39 0 top
R35035  10K  [0201]  238.71,22 0 top
R35036  10K  [0201]  238.71,22.61 0 top
R35037  10K  [0201]  238.71,23.22 0 top
R35038  10K  [0201]  238.71,23.83 0 top
R35039  10K  [0201]  238.71,24.43 0 top
R35040  10K  [0201]  238.71,25.04 0 top
R35041  10K  [0201]  238.71,25.65 0 top
R35042  10K  [0201]  238.71,26.26 0 top
R35043  10K  [0201]  238.71,26.87 0 top
R35044  10K  [0201]  238.71,27.48 0 top
R35045  10K  [0201]  238.71,28.09 0 top
R35046  10K  [0201]  238.71,28.7 0 top
R35047  10K  [0201]  238.71,29.31 0 top
R35048  10K  [0201]  238.71,29.92 0 top
R35049  10K  [0201]  238.71,30.53 0 top
R35050  10K  [0201]  238.71,31.14 0 top
R35051  10K  [0201]  238.71,31.75 0 top
R35052  10K  [0201]  238.71,32.36 0 top
R35053  10K  [0201]  238.71,32.97 0 top
R35054  10K  [0201]  238.71,33.58 0 top
R35055  10K  [0201]  238.71,34.19 0 top
R35056  10K  [0201]  238.71,34.8 0 top
R35057  10K  [0201]  238.71,35.41 0 top
R35058  10K  [0201]  238.71,36.02 0 top
R35059  10K  [0201]  238.71,36.63 0 top
R35060  10K  [0201]  238.71,37.24 0 top
R35061  10K  [0201]  238.71,37.85 0 top
R35062  10K  [0201]  238.71,38.46 0 top
R35063  10K  [0201]  238.71,39.07 0 top
R35064  10K  [0201]  238.71,39.67 0 top
R35065  10K  [0201]  238.71,40.28 0 top
R35066  10K  [0201]  238.71,40.89 0 top
R35067  10K  [0201]  238.71,41.5 0 top
R35068  10K  [0201]  238.71,42.11 0 top
R35069  10K  [0201]  238.71,42.72 0 top
R35070  10K  [0201]  238.71,43.33 0 top
R35071  10K  [0201]  238.71,43.94 0 top
R35072  10K  [0201]  238.71,44.55 0 top
R35073  10K  [0201]  238.71,45.16 0 top
R35074  10K  [0201]  238.71,45.77 0 top
R35075  10K  [0201]  238.71,46.38 0 top
R35076  10K  [0201]  238.71,46.99 0 top
R35077  10K  [0201]  238.71,47.6 0 top
R35078  10K  [0201]  238.71,48.21 0 top
R35079  10K  [0201]  238.71,48.82 0 top
R35080  10K  [0201]  238.71,49.43 0 top
R35081  10K  [0201]  238.71,50.04 0 top
R35082  10K  [0201]  238.71,50.65 0 top
R35083  10K  [0201]  238.71,51.26 0 top
R35084  10K  [0201]  238.71,51.87 0 top
R35085  10K  [0201]  238.71,52.48 0 top
R35086  10K  [0201]  238.71,53.09 0 top
R35087  10K  [0201]  238.71,53.7 0 top
R35088  10K  [0201]  238.71,54.31 0 top
R35089  10K  [0201]  238.71,54.91 0 top
R35090  10K  [0201]  238.71,55.52 0 top
R35091  10K  [0201]  238.71,56.13 0 top
R35092  10K  [0201]  238.71,56.74 0 top
R35093  10K  [0201]  238.71,57.35 0 top
R35094  10K  [0201]  238.71,57.96 0 top
R35095  10K  [0201]  238.71,58.57 0 top
R35096  10K  [0201]  238.71,59.18 0 top
R35097  10K  [0201]  238.71,59.79 0 top
R35098  10K  [0201]  238.71,60.4 0 top
R35099  10K  [0201]  238.71,61.01 0 top
R35100  10K  [0201]  238.71,61.62 0 top
R35101  10K  [0201]  238.71,62.23 0 top
R35102  10K  [0201]  238.71,62.84 0 top
R35103  10K  [0201]  238.71,63.45 0 top
R35104  10K  [0201]  238.71,64.06 0 top
R35105  10K  [0201]  238.71,64.67 0 top
R35106  10K  [0201]  238.71,65.28 0 top
R35107  10K  [0201]  238.71,65.89 0 top
R35108  10K  [0201]  238.71,66.5 0 top
R35109  10K  [0201]  238.71,67.11 0 top
R35110  10K  [0201]  238.71,67.72 0 top
R35111  10K  [0201]  238.71,68.33 0 top
R35112  10K  [0201]  238.71,68.94 0 top
R35113  10K  [0201]  238.71,69.55 0 top
R35114  10K  [0201]  238.71,70.15 0 top
R35115  10K  [0201]  238.71,70.76 0 top
R35116  10K  [0201]  238.71,71.37 0 top
R35117  10K  [0201]  238.71,71.98 0 top
R35118  10K  [0201]  238.71,72.59 0 top
R35119  10K  [0201]  238.71,73.2 0 top
R35120  10K  [0201]  238.71,73.81 0 top
R35121  10K  [0201]  238.71,74.42 0 top
R35122  10K  [0201]  238.71,75.03 0 top
R35123  10K  [0201]  238.71,75.64 0 top
R35124  10K  [0201]  238.71,76.25 0 top
R35125  10K  [0201]  238.71,76.86 0 top
R35126  10K  [0201]  238.71,77.47 0 top
R35127  10K  [0201]  238.71,78.08 0 top
R35128  10K  [0201]  238.71,78.69 0 top
R35129  10K  [0201]  238.71,79.3 0 top
R35130  10K  [0201]  238.71,79.91 0 top
R35131  10K  [0201]  238.71,80.52 0 top
R35132  10K  [0201]  238.71,81.13 0 top
R35133  10K  [0201]  238.71,81.74 0 top
R35134  10K  [0201]  238.71,82.35 0 top
R35135  10K  [0201]  238.71,82.96 0 top
R35136  10K  [0201]  238.71,83.57 0 top
R35137  10K  [0201]  238.71,84.18 0 top
R35138  10K  [0201]  238.71,84.79 0 top
R35139  10K  [0201]  238.71,85.39 0 top
R35140  10K  [0201]  238.71,86 0 top
R35141  10K  [0201]  238.71,86.61 0 top
R35142  10K  [0201]  238.71,87.22 0 top
R35143  10K  [0201]  238.71,87.83 0 top
R35144  10K  [0201]  238.71,88.44 0 top
R35145  10K  [0201]  238.71,89.05 0 top
R35146  10K  [0201]  238.71,89.66 0 top
R35147  10K  [0201]  238.71,90.27 0 top
R35148  10K  [0201]  238.71,90.88 0 top
R35149  10K  [0201]  238.71,91.49 0 top
R35150  10K  [0201]  238.71,92.1 0 top
R35151  10K  [0201]  238.71,92.71 0 top
R35152  10K  [0201]  238.71,93.32 0 top
R35153  10K  [0201]  238.71,93.93 0 top
R35154  10K  [0201]  238.71,94.54 0 top
R35155  10K  [0201]  238.71,95.15 0 top
R35156  10K  [0201]  238.71,95.76 0 top
R35157  10K  [0201]  238.71,96.37 0 top
R35158  10K  [0201]  238.71,96.98 0 top
R35159  10K  [0201]  238.71,97.59 0 top
R35160  10K  [0201]  238.71,98.2 0 top
R35161  10K  [0201]  238.71,98.81 0 top
R35162  10K  [0201]  238.71,99.42 0 top
R35163  10K  [0201]  238.71,100.03 0 top
R35164  10K  [0201]  238.71,100.63 0 top
R35165  10K  [0201]  238.71,101.24 0 top
R35166  10K  [0201]  238.71,101.85 0 top
R35167  10K  [0201]  238.71,102.46 0 top
R35168  10K  [0201]  238.71,103.07 0 top
R35169  10K  [0201]  238.71,103.68 0 top
R35170  10K  [0201]  238.71,104.29 0 top
R35171  10K  [0201]  238.71,104.9 0 top
R35172  10K  [0201]  238.71,105.51 0 top
R35173  10K  [0201]  238.71,106.12 0 top
R35174  10K  [0201]  238.71,106.73 0 top
R35175  10K  [0201]  238.71,107.34 0 top
R35176  10K  [0201]  238.71,107.95 0 top
R35177  10K  [0201]  238.71,108.56 0 top
R35178  10K  [0201]  238.71,109.17 0 top
R35179  10K  [0201]  238.71,109.78 0 top
R35180  10K  [0201]  238.71,110.39 0 top
R35181  10K  [0201]  238.71,111 0 top
R35182  10K  [0201]  238.71,111.61 0 top
R35183  10K  [0201]  238.71,112.22 0 top
R35184  10K  [0201]  238.71,112.83 0 top
R35185  10K  [0201]  238.71,113.44 0 top
R35186  10K  [0201]  238.71,114.05 0 top
R35187  10K  [0201]  238.71,114.66 0 top
R35188  10K  [0201]  238.71,115.27 0 top
R35189  10K  [0201]  238.71,115.87 0 top
R35190  10K  [0201]  238.71,116.48 0 top
R35191  10K  [0201]  238.71,117.09 0 top
R35192  10K  [0201]  238.71,117.7 0 top
R35193  10K  [0201]  238.71,118.31 0 top
R35194  10K  [0201]  238.71,118.92 0 top
R35195  10K  [0201]  238.71,119.53 0 top
R35196  10K  [0201]  238.71,120.14 0 top
R35197  10K  [0201]  238.71,120.75 0 top
R35198  10K  [0201]  238.71,121.36 0 top
R35199  10K  [0201]  238.71,121.97 0 top
R35200  10K  [0201]  238.71,122.58 0 top
R35201  10K  [0201]  239.93,1.27 0 top
R35202  10K  [0201]  239.93,1.88 0 top
R35203  10K  [0201]  239.93,2.49 0 top
R35204  10K  [0201]  239.93,3.1 0 top
R35205  10K  [0201]  239.93,3.71 0 top
R35206  10K  [0201]  239.93,4.32 0 top
R35207  10K  [0201]  239.93,4.93 0 top
R35208  10K  [0201]  239.93,5.54 0 top
R35209  10K  [0201]  239.93,6.15 0 top
R35210  10K  [0201]  239.93,6.76 0 top
R35211  10K  [0201]  239.93,7.37 0 top
R35212  10K  [0201]  239.93,7.98 0 top
R35213  10K  [0201]  239.93,8.59 0 top
R35214  10K  [0201]  239.93,9.19 0 top
R35215  10K  [0201]  239.93,9.8 0 top
R35216  10K  [0201]  239.93,10.41 0 top
R35217  10K  [0201]  239.93,11.02 0 top
R35218  10K  [0201]  239.93,11.63 0 top
R35219  10K  [0201]  239.93,12.24 0 top
R35220  10K  [0201]  239.93,12.85 0 top
R35221  10K  [0201]  239.93,13.46 0 top
R35222  10K  [0201]  239.93,14.07 0 top
R35223  10K  [0201]  239.93,14.68 0 top
R35224  10K  [0201]  239.93,15.29 0 top
R35225  10K  [0201]  239.93,15.9 0 top
R35226  10K  [0201]  239.93,16.51 0 top
R35227  10K  [0201]  239.93,17.12 0 top
R35228  10K  [0201]  239.93,17.73 0 top
R35229  10K  [0201]  239.93,18.34 0 top
R35230  10K  [0201]  239.93,18.95 0 top
R35231  10K  [0201]  239.93,19.56 0 top
R35232  10K  [0201]  239.93,20.17 0 top
R35233  10K  [0201]  239.93,20.78 0 top
R35234  10K  [0201]  239.93,21.39 0 top
R35235  10K  [0201]  239.93,22 0 top
R35236  10K  [0201]  239.93,22.61 0 top
R35237  10K  [0201]  239.93,23.22 0 top
R35238  10K  [0201]  239.93,23.83 0 top
R35239  10K  [0201]  239.93,24.43 0 top
R35240  10K  [0201]  239.93,25.04 0 top
R35241  10K  [0201]  239.93,25.65 0 top
R35242  10K  [0201]  239.93,26.26 0 top
R35243  10K  [0201]  239.93,26.87 0 top
R35244  10K  [0201]  239.93,27.48 0 top
R35245  10K  [0201]  239.93,28.09 0 top
R35246  10K  [0201]  239.93,28.7 0 top
R35247  10K  [0201]  239.93,29.31 0 top
R35248  10K  [0201]  239.93,29.92 0 top
R35249  10K  [0201]  239.93,30.53 0 top
R35250  10K  [0201]  239.93,31.14 0 top
R35251  10K  [0201]  239.93,31.75 0 top
R35252  10K  [0201]  239.93,32.36 0 top
R35253  10K  [0201]  239.93,32.97 0 top
R35254  10K  [0201]  239.93,33.58 0 top
R35255  10K  [0201]  239.93,34.19 0 top
R35256  10K  [0201]  239.93,34.8 0 top
R35257  10K  [0201]  239.93,35.41 0 top
R35258  10K  [0201]  239.93,36.02 0 top
R35259  10K  [0201]  239.93,36.63 0 top
R35260  10K  [0201]  239.93,37.24 0 top
R35261  10K  [0201]  239.93,37.85 0 top
R35262  10K  [0201]  239.93,38.46 0 top
R35263  10K  [0201]  239.93,39.07 0 top
R35264  10K  [0201]  239.93,39.67 0 top
R35265  10K  [0201]  239.93,40.28 0 top
R35266  10K  [0201]  239.93,40.89 0 top
R35267  10K  [0201]  239.93,41.5 0 top
R35268  10K  [0201]  239.93,42.11 0 top
R35269  10K  [0201]  239.93,42.72 0 top
R35270  10K  [0201]  239.93,43.33 0 top
R35271  10K  [0201]  239.93,43.94 0 top
R35272  10K  [0201]  239.93,44.55 0 top
R35273  10K  [0201]  239.93,45.16 0 top
R35274  10K  [0201]  239.93,45.77 0 top
R35275  10K  [0201]  239.93,46.38 0 top
R35276  10K  [0201]  239.93,46.99 0 top
R35277  10K  [0201]  239.93,47.6 0 top
R35278  10K  [0201]  239.93,48.21 0 top
R35279  10K  [0201]  239.93,48.82 0 top
R35280  10K  [0201]  239.93,49.43 0 top
R35281  10K  [0201]  239.93,50.04 0 top
R35282  10K  [0201]  239.93,50.65 0 top
R35283  10K  [0201]  239.93,51.26 0 top
R35284  10K  [0201]  239.93,51.87 0 top
R35285  10K  [0201]  239.93,52.48 0 top
R35286  10K  [0201]  239.93,53.09 0 top
R35287  10K  [0201]  239.93,53.7 0 top
R35288  10K  [0201]  239.93,54.31 0 top
R35289  10K  [0201]  239.93,54.91 0 top
R35290  10K  [0201]  239.93,55.52 0 top
R35291  10K  [0201]  239.93,56.13 0 top
R35292  10K  [0201]  239.93,56.74 0 top
R35293  10K  [0201]  239.93,57.35 0 top
R35294  10K  [0201]  239.93,57.96 0 top
R35295  10K  [0201]  239.93,58.57 0 top
R35296  10K  [0201]  239.93,59.18 0 top
R35297  10K  [0201]  239.93,59.79 0 top
R35298  10K  [0201]  239.93,60.4 0 top
R35299  10K  [0201]  239.93,61.01 0 top
R35300  10K  [0201]  239.93,61.62 0 top
R35301  10K  [0201]  239.93,62.23 0 top
R35302  10K  [0201]  239.93,62.84 0 top
R35303  10K  [0201]  239.93,63.45 0 top
R35304  10K  [0201]  239.93,64.06 0 top
R35305  10K  [0201]  239.93,64.67 0 top
R35306  10K  [0201]  239.93,65.28 0 top
R35307  10K  [0201]  239.93,65.89 0 top
R35308  10K  [0201]  239.93,66.5 0 top
R35309  10K  [0201]  239.93,67.11 0 top
R35310  10K  [0201]  239.93,67.72 0 top
R35311  10K  [0201]  239.93,68.33 0 top
R35312  10K  [0201]  239.93,68.94 0 top
R35313  10K  [0201]  239.93,69.55 0 top
R35314  10K  [0201]  239.93,70.15 0 top
R35315  10K  [0201]  239.93,70.76 0 top
R35316  10K  [0201]  239.93,71.37 0 top
R35317  10K  [0201]  239.93,71.98 0 top
R35318  10K  [0201]  239.93,72.59 0 top
R35319  10K  [0201]  239.93,73.2 0 top
R35320  10K  [0201]  239.93,73.81 0 top
R35321  10K  [0201]  239.93,74.42 0 top
R35322  10K  [0201]  239.93,75.03 0 top
R35323  10K  [0201]  239.93,75.64 0 top
R35324  10K  [0201]  239.93,76.25 0 top
R35325  10K  [0201]  239.93,76.86 0 top
R35326  10K  [0201]  239.93,77.47 0 top
R35327  10K  [0201]  239.93,78.08 0 top
R35328  10K  [0201]  239.93,78.69 0 top
R35329  10K  [0201]  239.93,79.3 0 top
R35330  10K  [0201]  239.93,79.91 0 top
R35331  10K  [0201]  239.93,80.52 0 top
R35332  10K  [0201]  239.93,81.13 0 top
R35333  10K  [0201]  239.93,81.74 0 top
R35334  10K  [0201]  239.93,82.35 0 top
R35335  10K  [0201]  239.93,82.96 0 top
R35336  10K  [0201]  239.93,83.57 0 top
R35337  10K  [0201]  239.93,84.18 0 top
R35338  10K  [0201]  239.93,84.79 0 top
R35339  10K  [0201]  239.93,85.39 0 top
R35340  10K  [0201]  239.93,86 0 top
R35341  10K  [0201]  239.93,86.61 0 top
R35342  10K  [0201]  239.93,87.22 0 top
R35343  10K  [0201]  239.93,87.83 0 top
R35344  10K  [0201]  239.93,88.44 0 top
R35345  10K  [0201]  239.93,89.05 0 top
R35346  10K  [0201]  239.93,89.66 0 top
R35347  10K  [0201]  239.93,90.27 0 top
R35348  10K  [0201]  239.93,90.88 0 top
R35349  10K  [0201]  239.93,91.49 0 top
R35350  10K  [0201]  239.93,92.1 0 top
R35351  10K  [0201]  239.93,92.71 0 top
R35352  10K  [0201]  239.93,93.32 0 top
R35353  10K  [0201]  239.93,93.93 0 top
R35354  10K  [0201]  239.93,94.54 0 top
R35355  10K  [0201]  239.93,95.15 0 top
R35356  10K  [0201]  239.93,95.76 0 top
R35357  10K  [0201]  239.93,96.37 0 top
R35358  10K  [0201]  239.93,96.98 0 top
R35359  10K  [0201]  239.93,97.59 0 top
R35360  10K  [0201]  239.93,98.2 0 top
R35361  10K  [0201]  239.93,98.81 0 top
R35362  10K  [0201]  239.93,99.42 0 top
R35363  10K  [0201]  239.93,100.03 0 top
R35364  10K  [0201]  239.93,100.63 0 top
R35365  10K  [0201]  239.93,101.24 0 top
R35366  10K  [0201]  239.93,101.85 0 top
R35367  10K  [0201]  239.93,102.46 0 top
R35368  10K  [0201]  239.93,103.07 0 top
R35369  10K  [0201]  239.93,103.68 0 top
R35370  10K  [0201]  239.93,104.29 0 top
R35371  10K  [0201]  239.93,104.9 0 top
R35372  10K  [0201]  239.93,105.51 0 top
R35373  10K  [0201]  239.93,106.12 0 top
R35374  10K  [0201]  239.93,106.73 0 top
R35375  10K  [0201]  239.93,107.34 0 top
R35376  10K  [0201]  239.93,107.95 0 top
R35377  10K  [0201]  239.93,108.56 0 top
R35378  10K  [0201]  239.93,109.17 0 top
R35379  10K  [0201]  239.93,109.78 0 top
R35380  10K  [0201]  239.93,110.39 0 top
R35381  10K  [0201]  239.93,111 0 top
R35382  10K  [0201]  239.93,111.61 0 top
R35383  10K  [0201]  239.93,112.22 0 top
R35384  10K  [0201]  239.93,112.83 0 top
R35385  10K  [0201]  239.93,113.44 0 top
R35386  10K  [0201]  239.93,114.05 0 top
R35387  10K  [0201]  239.93,114.66 0 top
R35388  10K  [0201]  239.93,115.27 0 top
R35389  10K  [0201]  239.93,115.87 0 top
R35390  10K  [0201]  239.93,116.48 0 top
R35391  10K  [0201]  239.93,117.09 0 top
R35392  10K  [0201]  239.93,117.7 0 top
R35393  10K  [0201]  239.93,118.31 0 top
R35394  10K  [0201]  239.93,118.92 0 top
R35395  10K  [0201]  239.93,119.53 0 top
R35396  10K  [0201]  239.93,120.14 0 top
R35397  10K  [0201]  239.93,120.75 0 top
R35398  10K  [0201]  239.93,121.36 0 top
R35399  10K  [0201]  239.93,121.97 0 top
R35400  10K  [0201]  239.93,122.58 0 top
R35401  10K  [0201]  241.15,1.27 0 top
R35402  10K  [0201]  241.15,1.88 0 top
R35403  10K  [0201]  241.15,2.49 0 top
R35404  10K  [0201]  241.15,3.1 0 top
R35405  10K  [0201]  241.15,3.71 0 top
R35406  10K  [0201]  241.15,4.32 0 top
R35407  10K  [0201]  241.15,4.93 0 top
R35408  10K  [0201]  241.15,5.54 0 top
R35409  10K  [0201]  241.15,6.15 0 top
R35410  10K  [0201]  241.15,6.76 0 top
R35411  10K  [0201]  241.15,7.37 0 top
R35412  10K  [0201]  241.15,7.98 0 top
R35413  10K  [0201]  241.15,8.59 0 top
R35414  10K  [0201]  241.15,9.19 0 top
R35415  10K  [0201]  241.15,9.8 0 top
R35416  10K  [0201]  241.15,10.41 0 top
R35417  10K  [0201]  241.15,11.02 0 top
R35418  10K  [0201]  241.15,11.63 0 top
R35419  10K  [0201]  241.15,12.24 0 top
R35420  10K  [0201]  241.15,12.85 0 top
R35421  10K  [0201]  241.15,13.46 0 top
R35422  10K  [0201]  241.15,14.07 0 top
R35423  10K  [0201]  241.15,14.68 0 top
R35424  10K  [0201]  241.15,15.29 0 top
R35425  10K  [0201]  241.15,15.9 0 top
R35426  10K  [0201]  241.15,16.51 0 top
R35427  10K  [0201]  241.15,17.12 0 top
R35428  10K  [0201]  241.15,17.73 0 top
R35429  10K  [0201]  241.15,18.34 0 top
R35430  10K  [0201]  241.15,18.95 0 top
R35431  10K  [0201]  241.15,19.56 0 top
R35432  10K  [0201]  241.15,20.17 0 top
R35433  10K  [0201]  241.15,20.78 0 top